# Altium schematic sheet phototransistors.SchDoc: Phototransostors (part 1 of 3)
size A2; Revision: 1.0.0; SheetNumber: 2; SheetTotal: 10
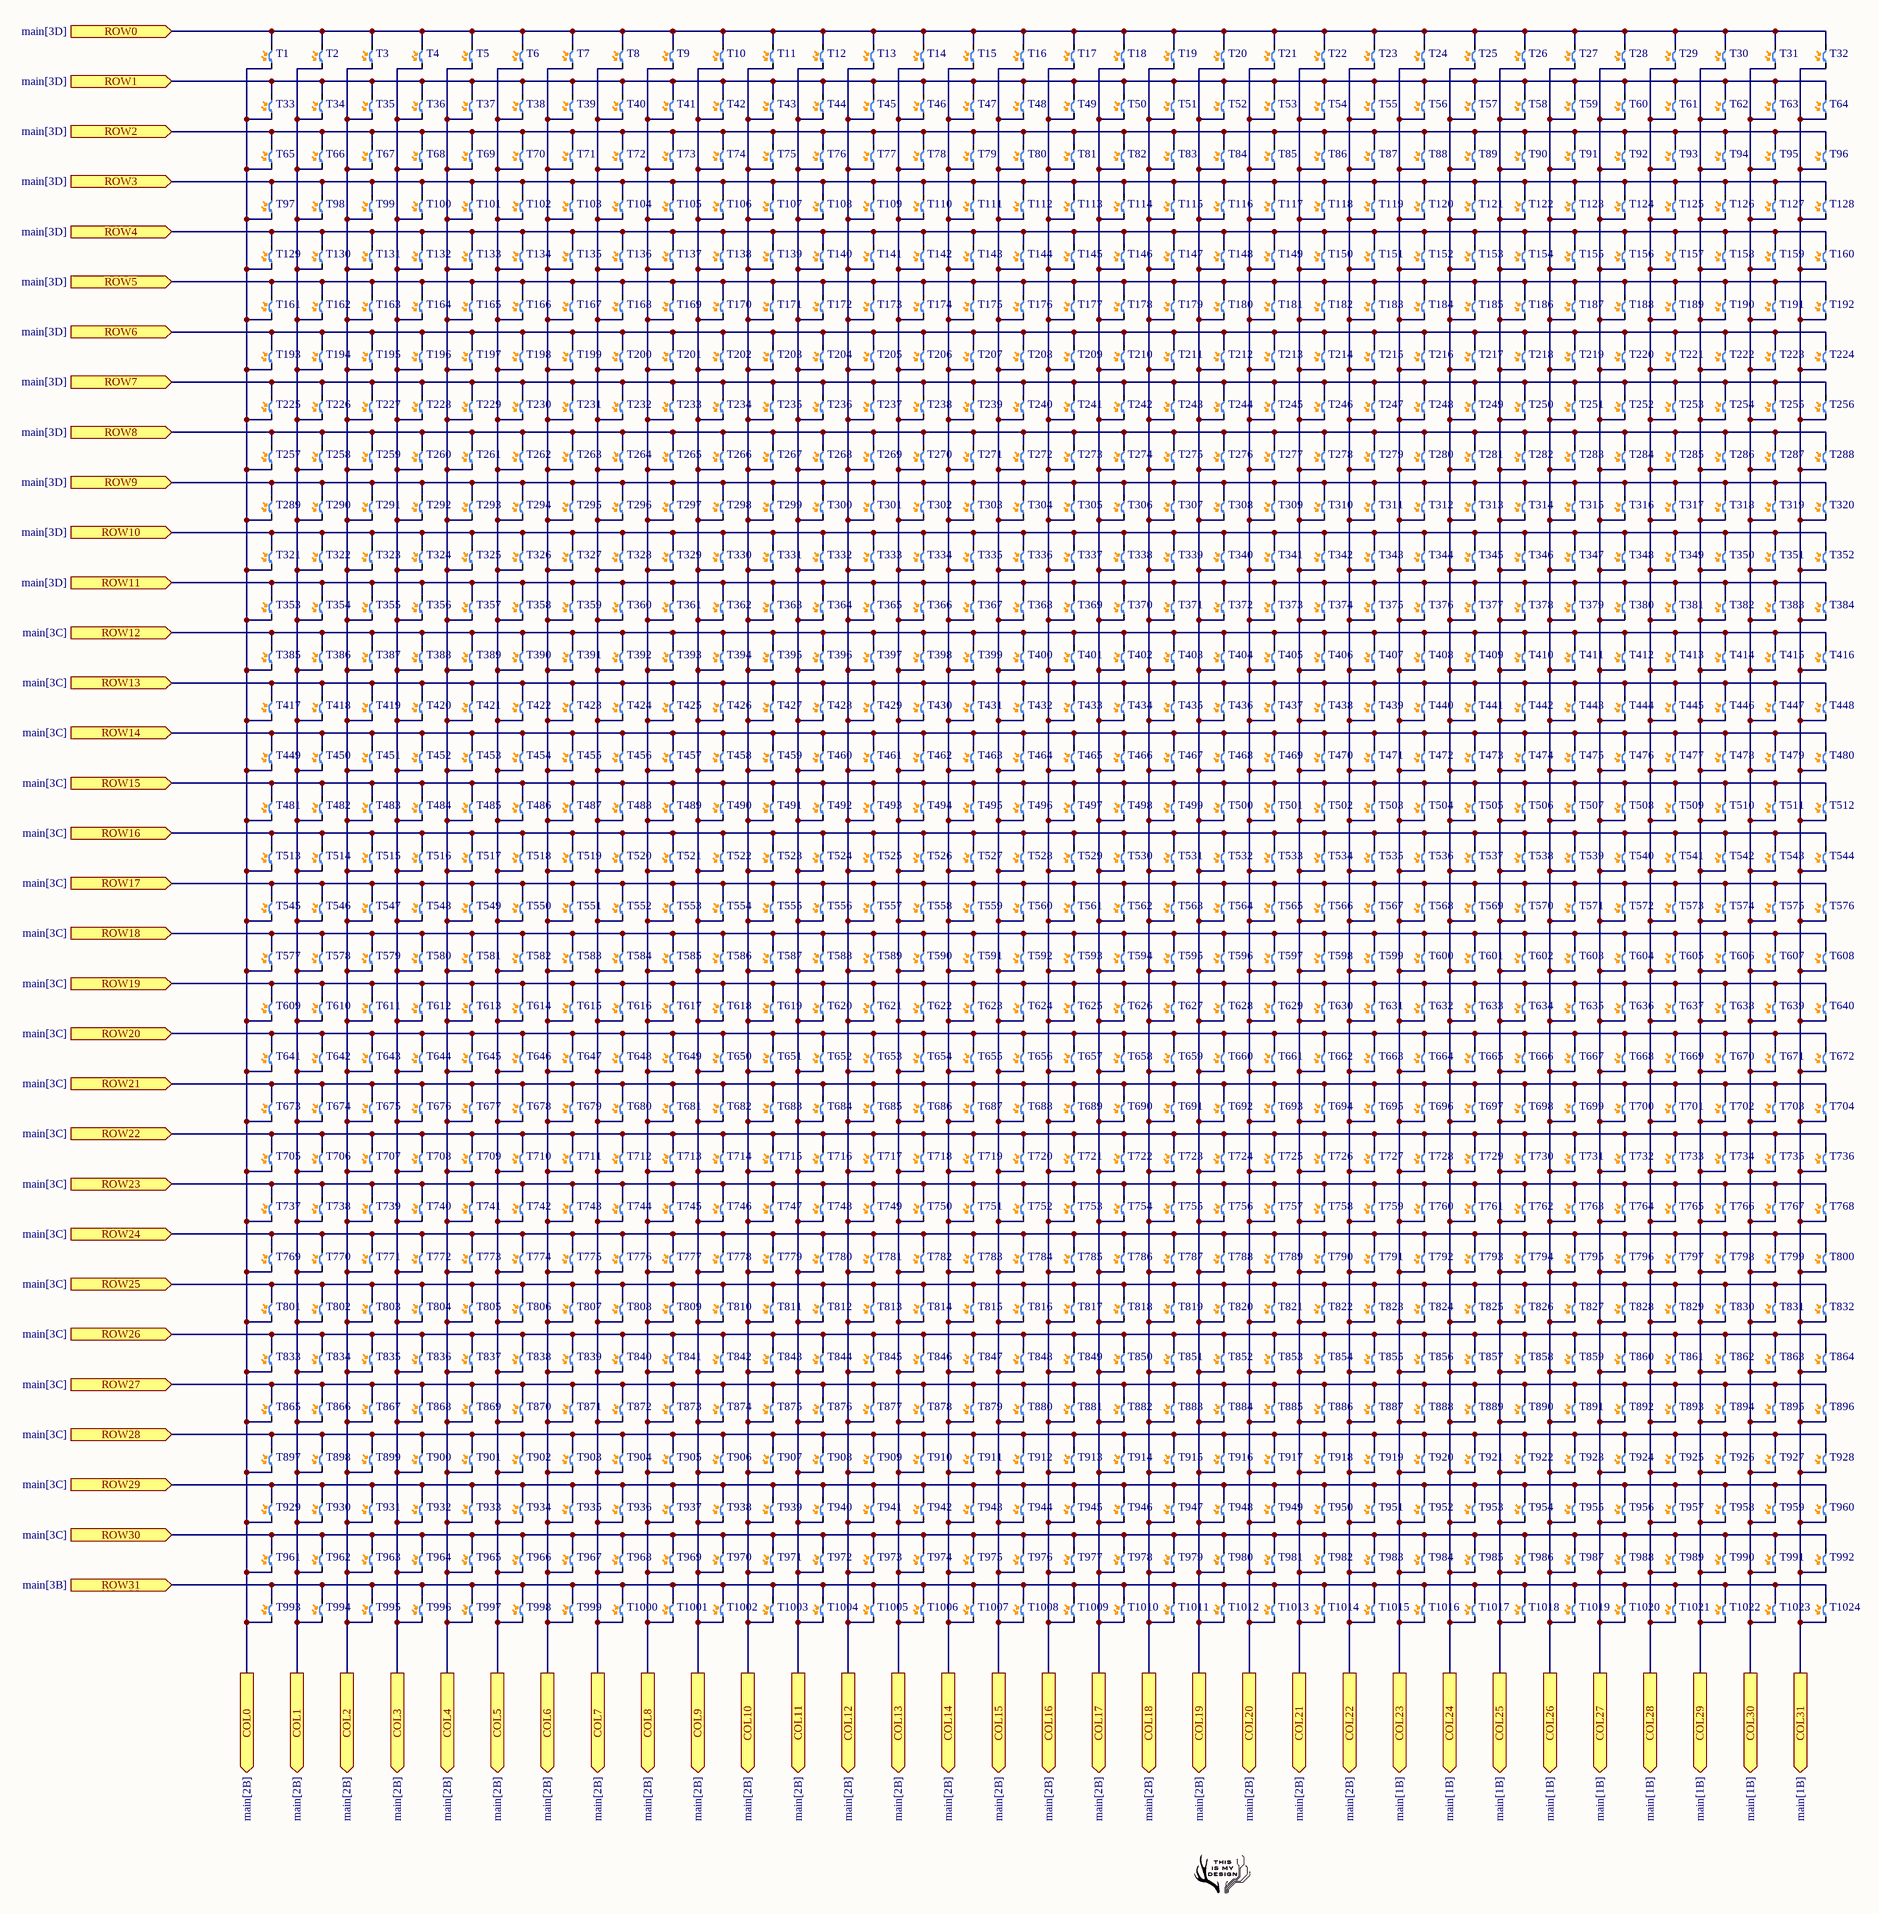
[diagram p0: phototransistors.SchDoc]